# EasyEDA Pro project ProProject_Avaota Pi A_2024-03-25.epro, board PCB1 (continued)
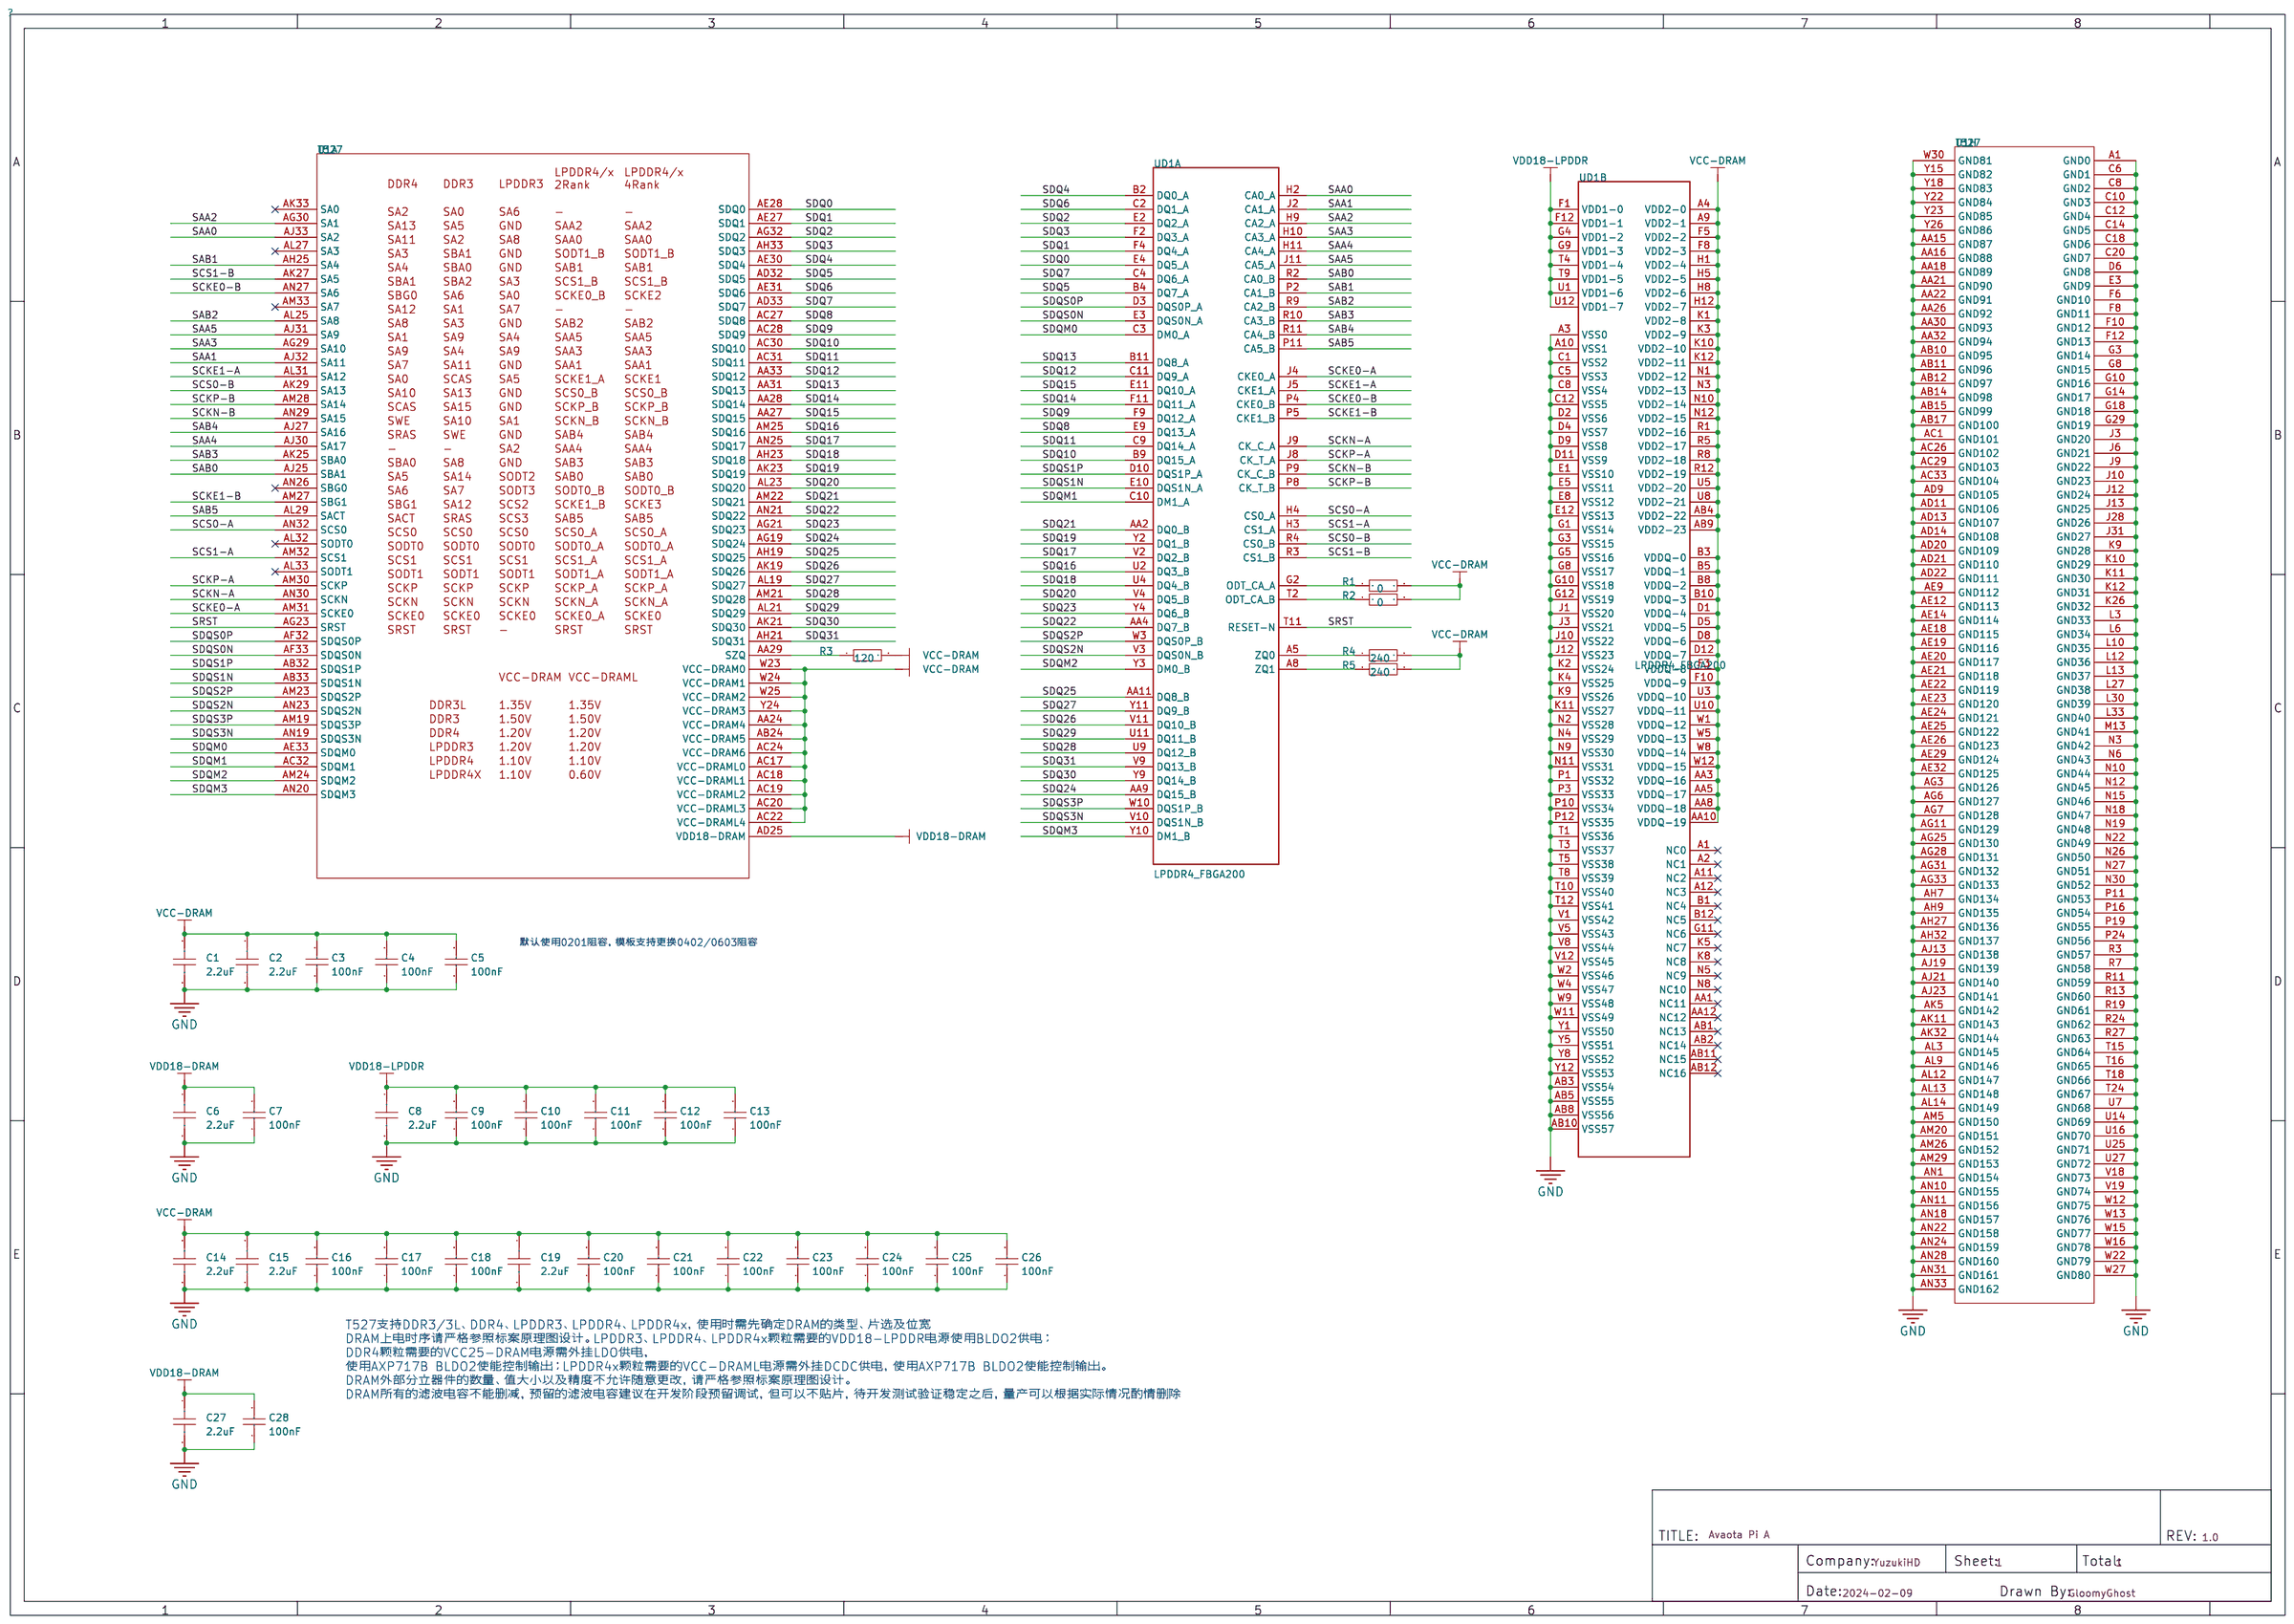
[diagram p0: schematic sheet]
## Copper pours and planes (outline as drawn; the poured copper is in the pictures) (continued)
GND on GND2: 60.51,45.48 59.09,45.48 58.79,45.78 58.79,48.22 57.97,49.03 51.8,49.03 45.35,55.49 32.42,55.49 31.91,54.98 31.91,39.51 34.86,36.56 59.14,36.56 60.79,38.21 60.79,45.2
VBUS on Top Layer: 3.96,50.6 6.02,50.6 6.02,48.36 3.96,48.36
VBUS on Top Layer: 3.45,49.23 13.41,49.23 13.41,42.39 3.45,42.39
323-DCDC1/2 on Top Layer: 20.45,45.29 22.86,45.29 22.86,40.67 20.45,40.67
323-DCDC1/2 on 内层2: 59.33,48.43 59.33,45.81 59.95,45.19 62.33,45.19 62.69,45.54 62.69,50.4 52.53,60.55 32.16,60.55 27.2,55.6 27.2,52.68 20.5,45.97 20.5,41.22 21.77,39.95 23.22,39.95 25.32,42.06 25.32,44.7 31.27,50.65 31.27,54.28 32.92,55.93 47.62,55.93 54.58,48.97 58.79,48.97
323-DCDC3 on Top Layer: 15.9,48.71 19,48.71 19,47.07 15.9,47.07
323-DCDC3 on VCC: 60.81,50.9 60.81,49.91 60.3,49.4 57.51,49.4 57.48,49.43 52.22,49.43 45.82,55.83 31.75,55.83 22.22,46.3 18.03,46.3 16.71,47.61 16.71,49.15 18.97,51.41 21.72,51.41 30.4,60.1 47.65,60.1 55.6,52.15 59.56,52.15
BLDO2 on Bottom Layer: 43.23,38.99 44.66,40.42 44.66,53.91 43.31,55.27 33.34,55.27 32.02,53.96 32.02,40.14 33.17,38.99
DCDC1 on Top Layer: 11.15,47.96 13.39,47.96 13.39,45.82 11.15,45.82
DCDC1 on Bottom Layer: 10.85,47.95 12.75,47.95 12.75,45.75 10.85,45.75
DCDC1 on Inner5: 61.16,47.52 61.16,46.23 60.76,45.82 59.77,45.82 58.93,46.66 58.93,48.01 57.34,49.6 52.61,49.6 46.2,56.01 32.61,56.01 25.7,49.1 17.98,49.1 13.59,44.7 11.31,44.7 10.19,45.82 10.19,48.49 15.07,53.37 22.1,53.37 29.84,61.11 45.62,61.11 48.41,58.32 52.04,58.32 61.14,49.22 61.14,47.55
DCDC2 on Top Layer: 4.62,59.28 8.66,59.28 8.66,56.95 4.62,56.95
DCDC2 on 内层4: 58.52,49.57 58.52,49.61 52.04,49.61 45.54,56.11 19.99,56.11 16.81,59.28 14.5,59.28 13.87,59.92 10.44,59.92 9.22,58.7 9.22,57.53 8.79,57.1 6.02,57.1 5.36,57.76 5.36,60.45 7.67,62.76 20.43,62.76 22.82,60.38 54.08,60.38 65.23,49.23 65.81,49.23 66.12,48.92 66.12,48.01 63.73,45.62 63.09,45.62 62.81,45.9 62.28,45.9 62.03,46.15 62.03,47.21 61.77,47.47 60.62,47.47
DCDC3 on Top Layer: 10.69,59.97 13.41,59.97 13.41,55.73 10.69,55.73
DCDC3 on 内层4: 10.38,57.89 10.38,55.3 10.84,54.84 12.85,54.84 14.94,52.76 14.94,51.87 17.6,49.2 32.23,49.2 33.98,50.95 33.98,55.4 19.58,55.4 16.56,58.42 14.25,58.42 13.44,59.23 11.72,59.23
DCDC3 on 内层4: 60.52,45.45 59.1,45.45 58.79,45.76 58.79,48.2 58.29,48.7 51.94,48.7 45.23,55.41 32.38,55.41 31.92,54.95 31.92,39.48 34.87,36.54 59.15,36.54 60.8,38.19 60.8,45.17
DCDC4 on Bottom Layer: 3.28,54.13 5.92,54.13 5.92,52.76 3.28,52.76
DCDC4 on VCC: 2.69,54.23 4.79,54.23 4.79,52.22 2.69,52.22
DCIN-5V on Top Layer: 3.81,44.54 8.41,44.54 8.41,38.46 3.81,38.46
DCIN-12V on Top Layer: 4.95,23.34 17.83,23.34 17.83,19.84 4.95,19.84
DCIN-12V on Top Layer: 9.27,31.93 12.7,31.93 12.7,21.59 9.27,21.59
DCIN-12V on Top Layer: 17.09,25.35 17.93,25.35 17.93,21.86 17.09,21.86
GM0_DVDD10 on Top Layer: 61.45,27.48 63.04,27.48 63.04,25.76 61.45,25.76
GM0_REGOUT on Top Layer: 63.7,27.48 64.92,27.48 64.92,24.51 63.7,24.51
GM1_DVDD10 on Top Layer: 79.61,27.33 81.2,27.33 81.2,25.6 79.61,25.6
GM1_REGOUT on Top Layer: 81.86,27.32 83.09,27.32 83.09,24.35 81.86,24.35
PS on Top Layer: 5.44,51.54 6.68,51.54 6.68,50.55 5.44,50.55
PS on Top Layer: 5.44,53.16 6.63,53.16 6.63,52.15 5.44,52.15
PS on 内层2: 6.71,55.99 13.01,55.99 14.76,54.25 14.76,49.1 19.25,44.6 19.25,41.15 18.44,40.34 15.19,40.34 10.21,45.31 5.21,45.31 3.15,47.37 3.15,54.64 4.23,55.72 6.43,55.72
$1N3706 on Top Layer: 9.37,49.23 10.54,49.23 10.54,47.47 9.37,47.47
$1N3718 on Top Layer: 7.68,56.45 8.85,56.45 8.85,54.45 7.68,54.45
$1N3723 on Top Layer: 9.14,56 10.31,56 10.31,54.45 9.14,54.45
$1N4773 on Top Layer: 4.47,54.81 6.04,54.81 6.04,53.33 4.47,53.33
$1N4992 on Top Layer: 2.89,52.38 6.06,52.38 6.06,50.85 2.89,50.85
$1N6251 on Top Layer: 17.3,43.19 19.89,43.19 19.89,40.77 17.3,40.77
$1N6517 on Top Layer: 17.3,45.21 19.89,45.21 19.89,43.08 17.3,43.08
$1N6728 on Top Layer: 15.88,46.96 17.88,46.96 17.88,44.07 15.88,44.07
$12N612 on Top Layer: 14.53,19.1 19.51,19.1 19.51,8.76 14.53,8.76
$12N1559 on Top Layer: 3.81,37.41 11.23,37.41 11.23,32.49 3.81,32.49
$12N1559 on Top Layer: 6.25,35.87 9.17,35.87 9.17,29.9 6.25,29.9

Small or netless copper shapes (teardrops, artwork), in the pictures only: 2335 on Top Layer, 989 on Bottom Layer, 223 on 内层2, 65 on VCC, 64 on 内层4, 170 on Inner5, 10 on GND2

## Text on the board
Bottom Silkscreen Layer: BIOS | FEL | RST | v1.2 | RGB888/LVDS/MIPI DSI/JTAG / UART/IIC/I2S/SPI/PWM  MUX | TFCard/JTAG | OV13850 | Avaota A1
Top Silkscreen Layer: FAN | ON | LPDDR4 | Allwinner T527 | eMMC | RGB LED | 9~12V@2A DC | USB | HDMI | DP | GPIO | ETH1 | ETH0 | CAN | AUDIO | OTG&D | IR | Avaota A1 | 拆拆我的
